# EasyEDA Pro project 硬触发测试_2024-02-21_17-27-05(1).eprj, schematic Schematic1

## Sheets
1 mcu: Create Date: 2024-03-04; Page Name: mcu; Project Name: 硬触发测试_2024-02-21_17-27-05; Schematic Name: Schematic1; Update Date: 2024-03-18; Company: 嘉立创EDA; Page Size: A4; Version: V1.0
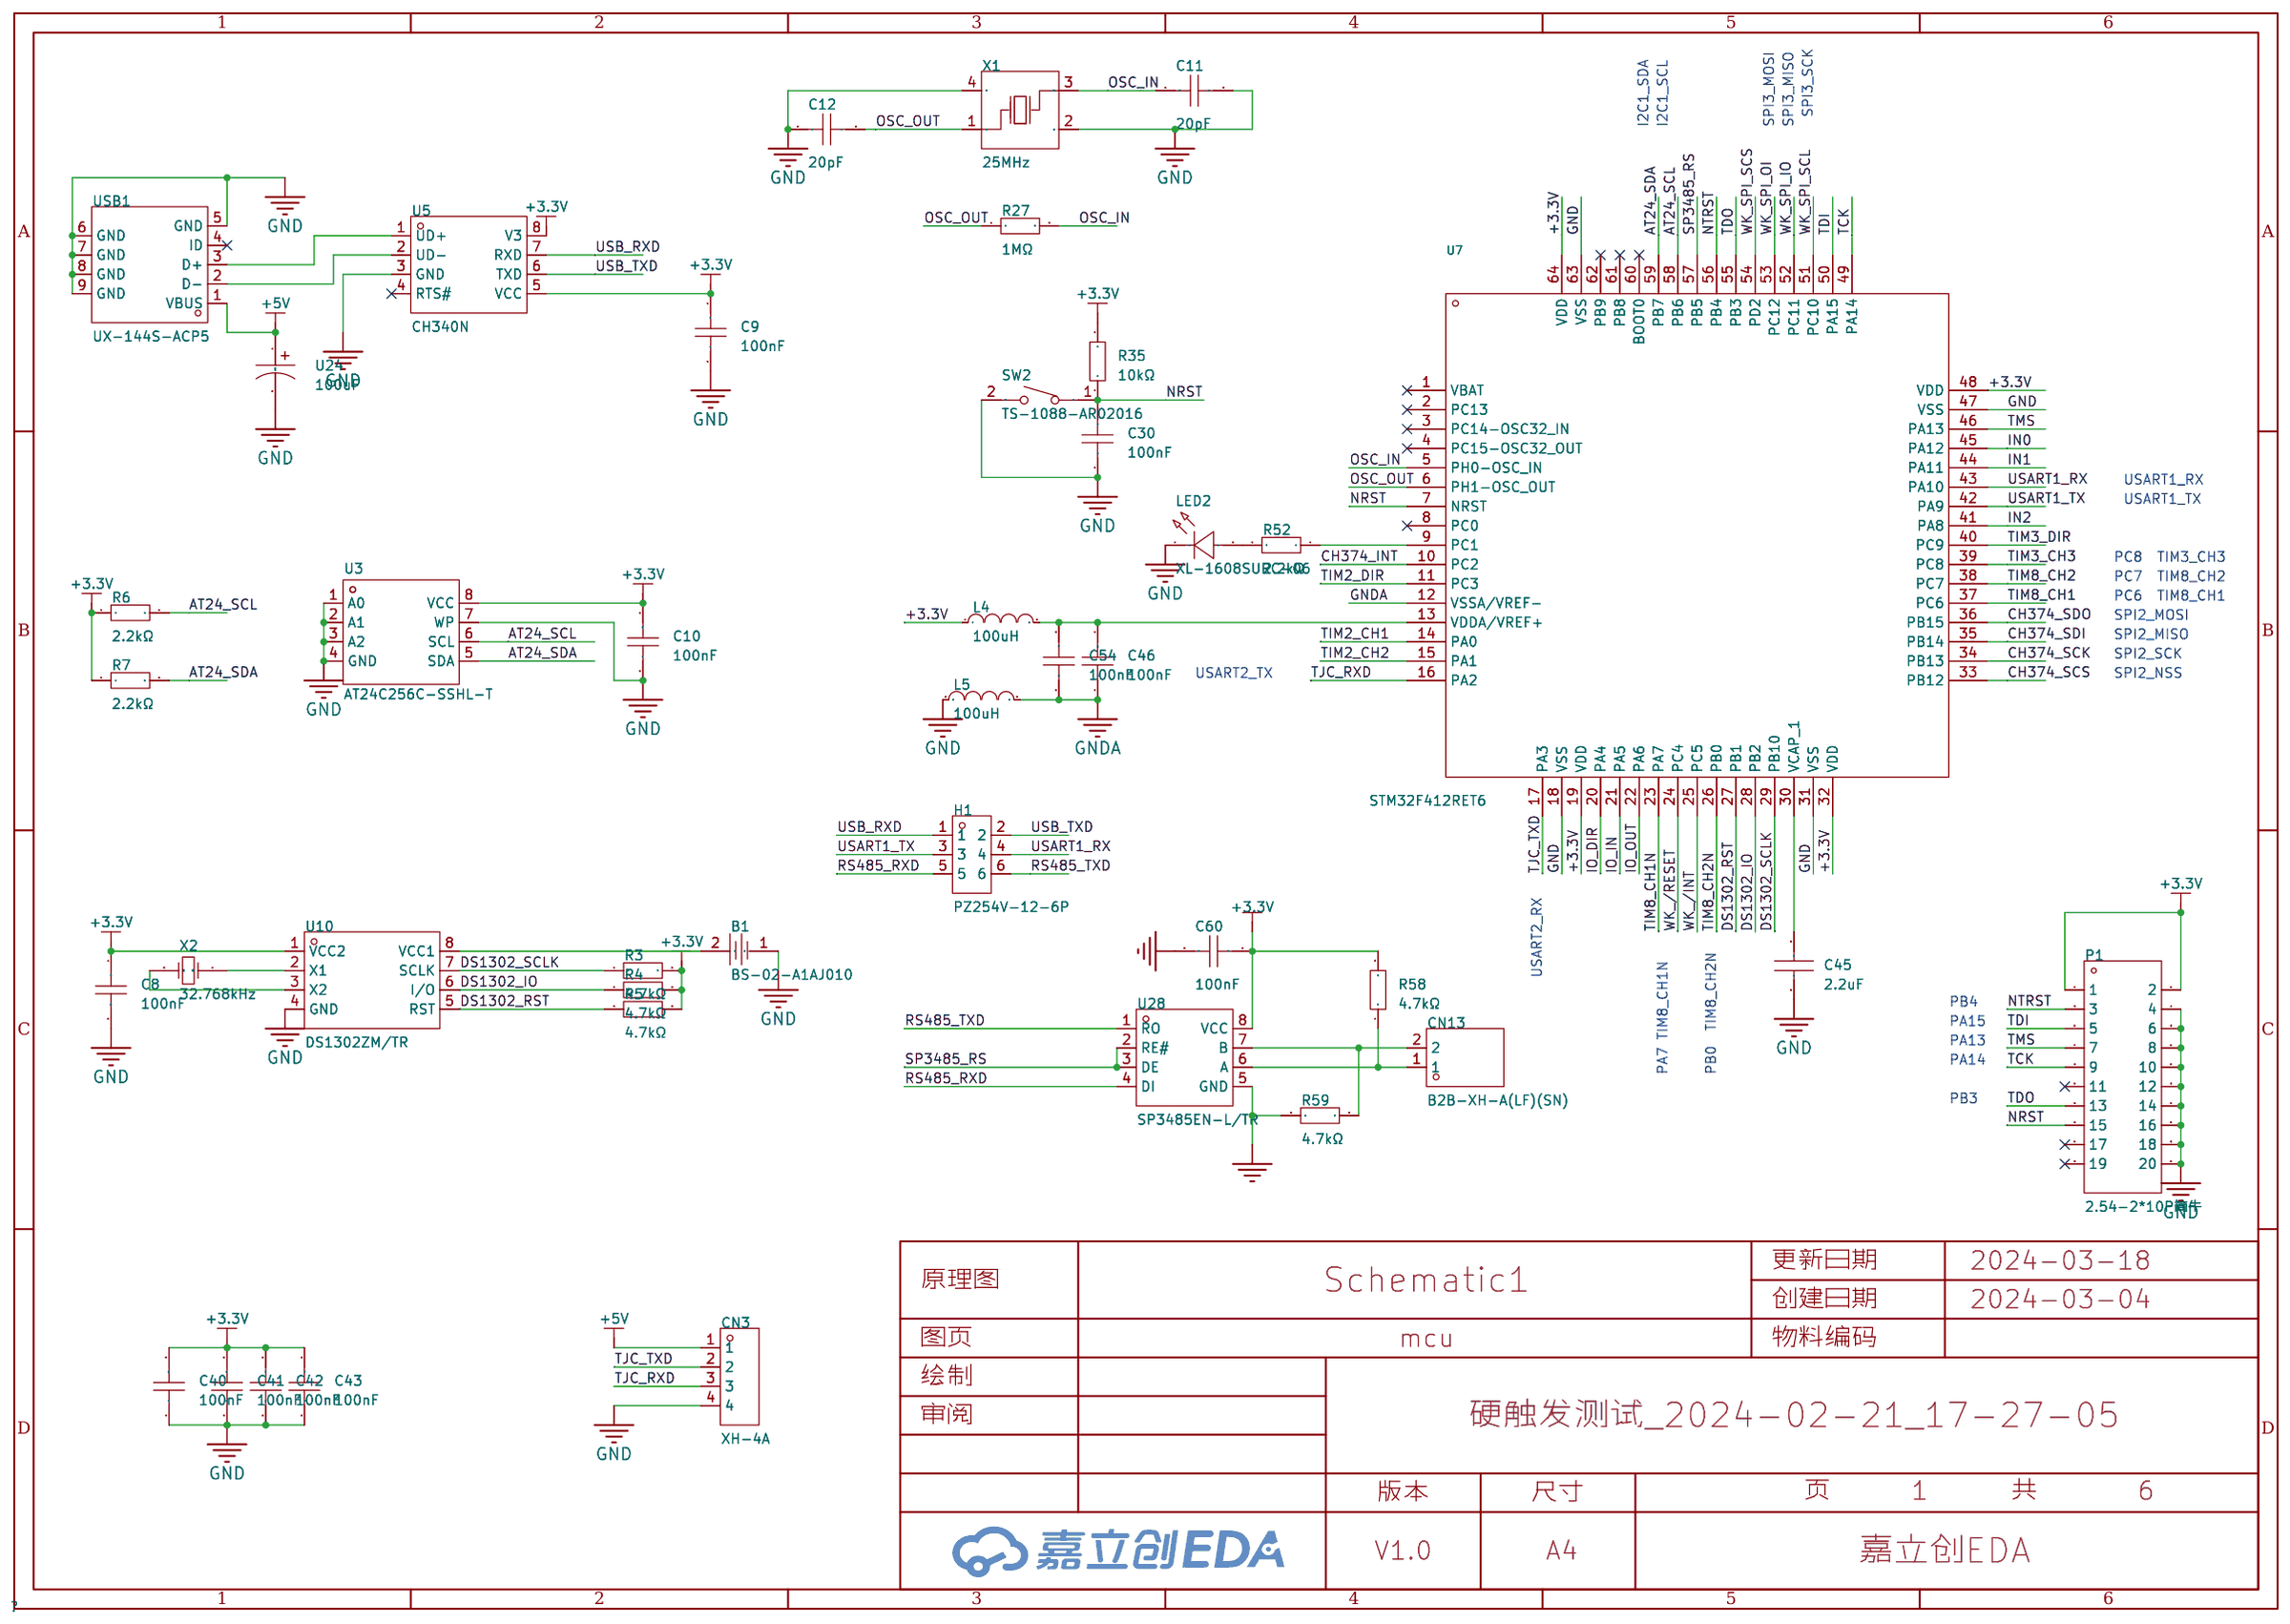
[diagram p0: mcu]
2 usb: Page Name: usb; Update Date: 2024-03-04
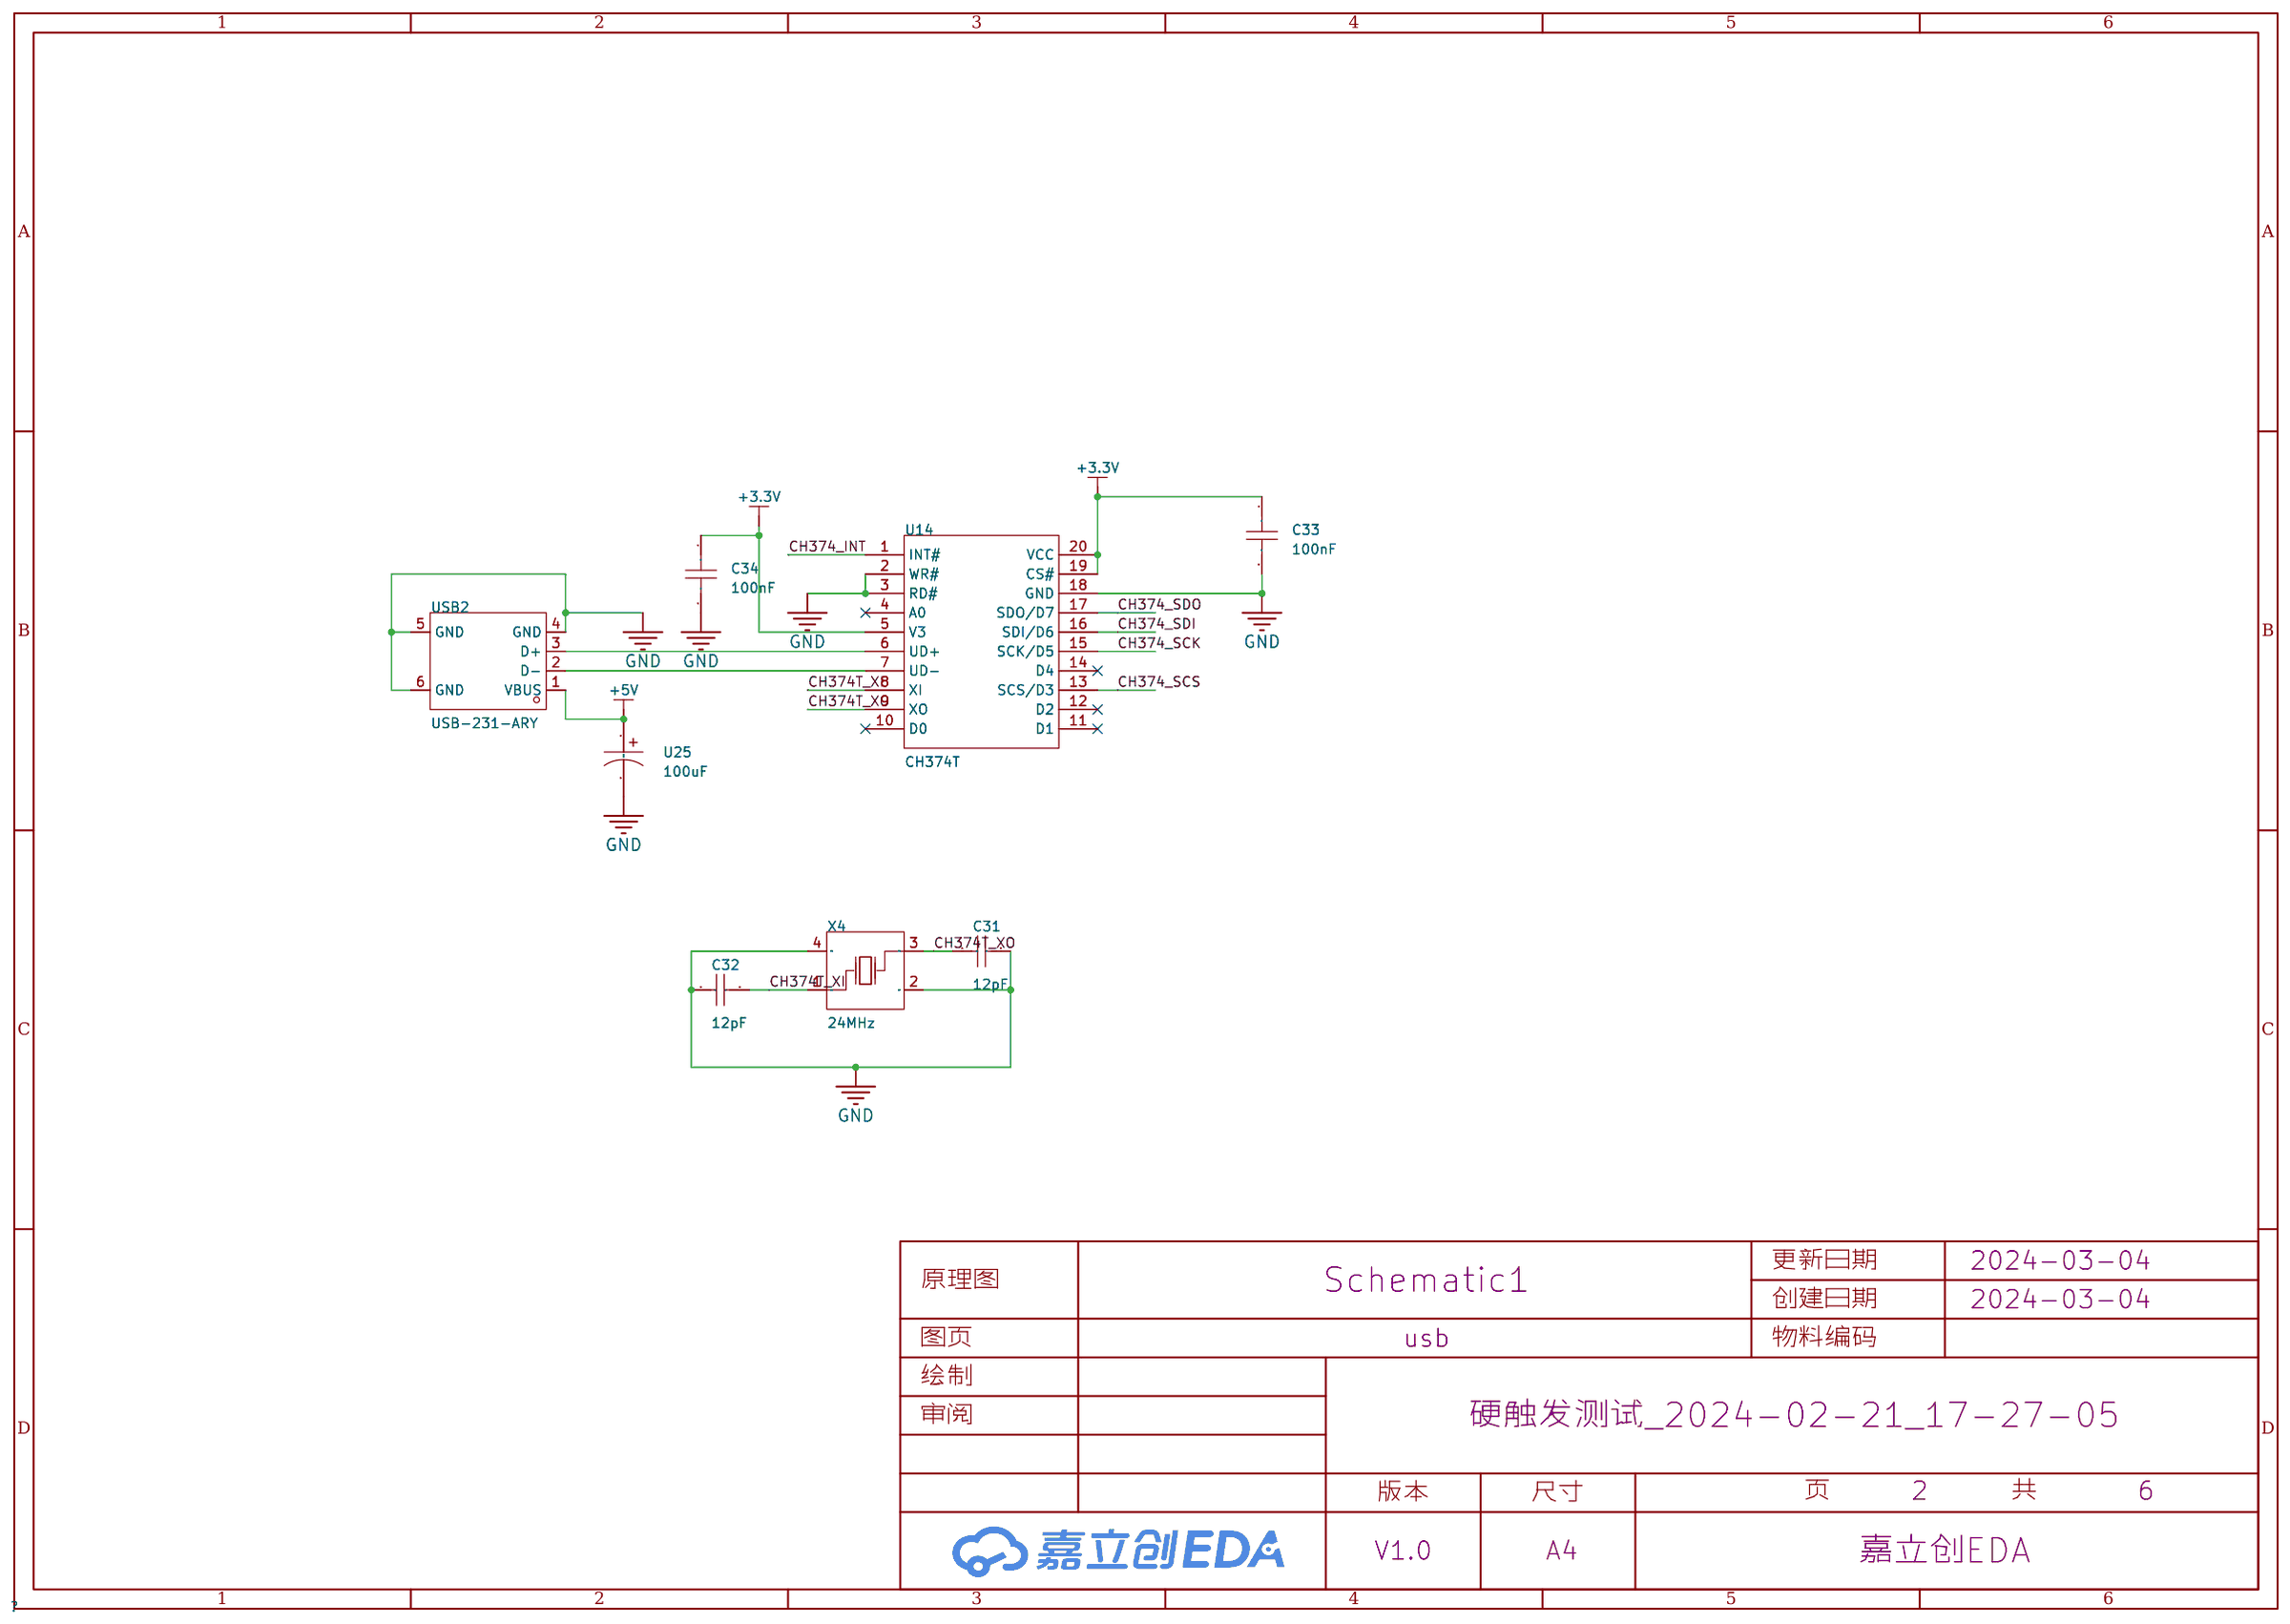
[diagram p1: usb]
3 网口: Page Name: 网口; Update Date: 2024-03-04
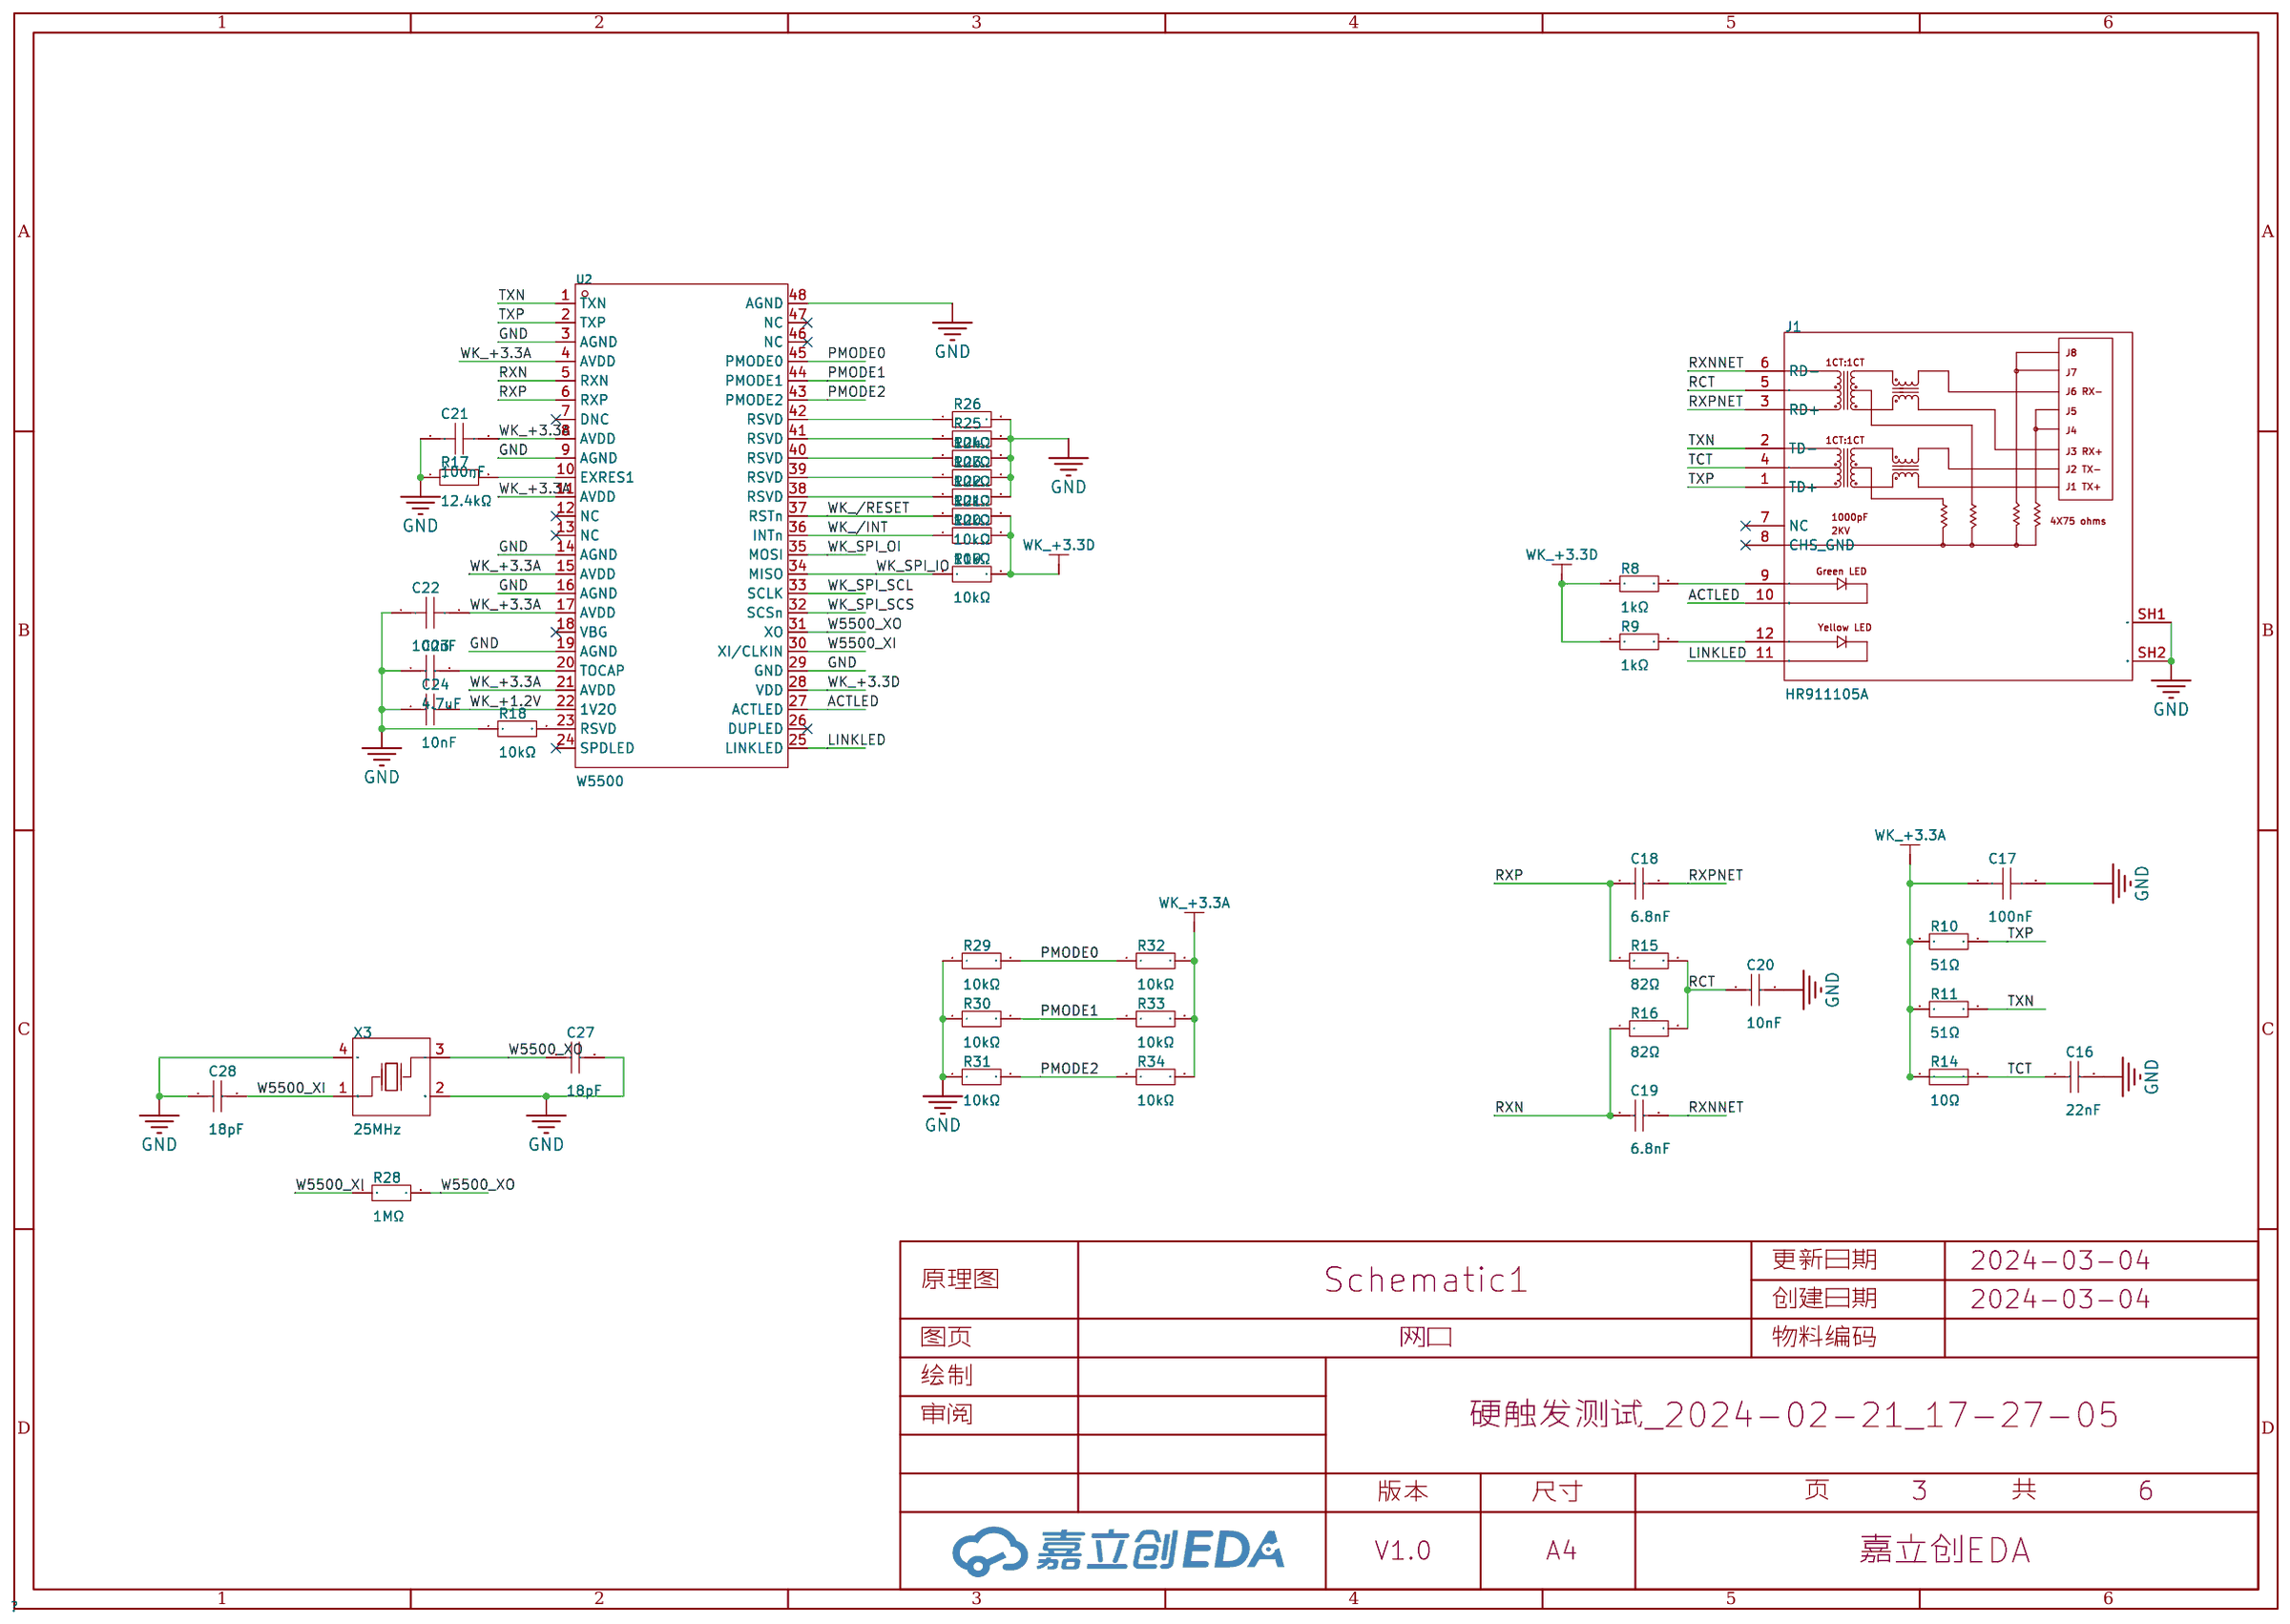
[diagram p2: 网口]
4 电源: Page Name: 电源; Update Date: 2024-03-22